# Altium schematic sheet fpga.SchDoc (part 3 of 3)
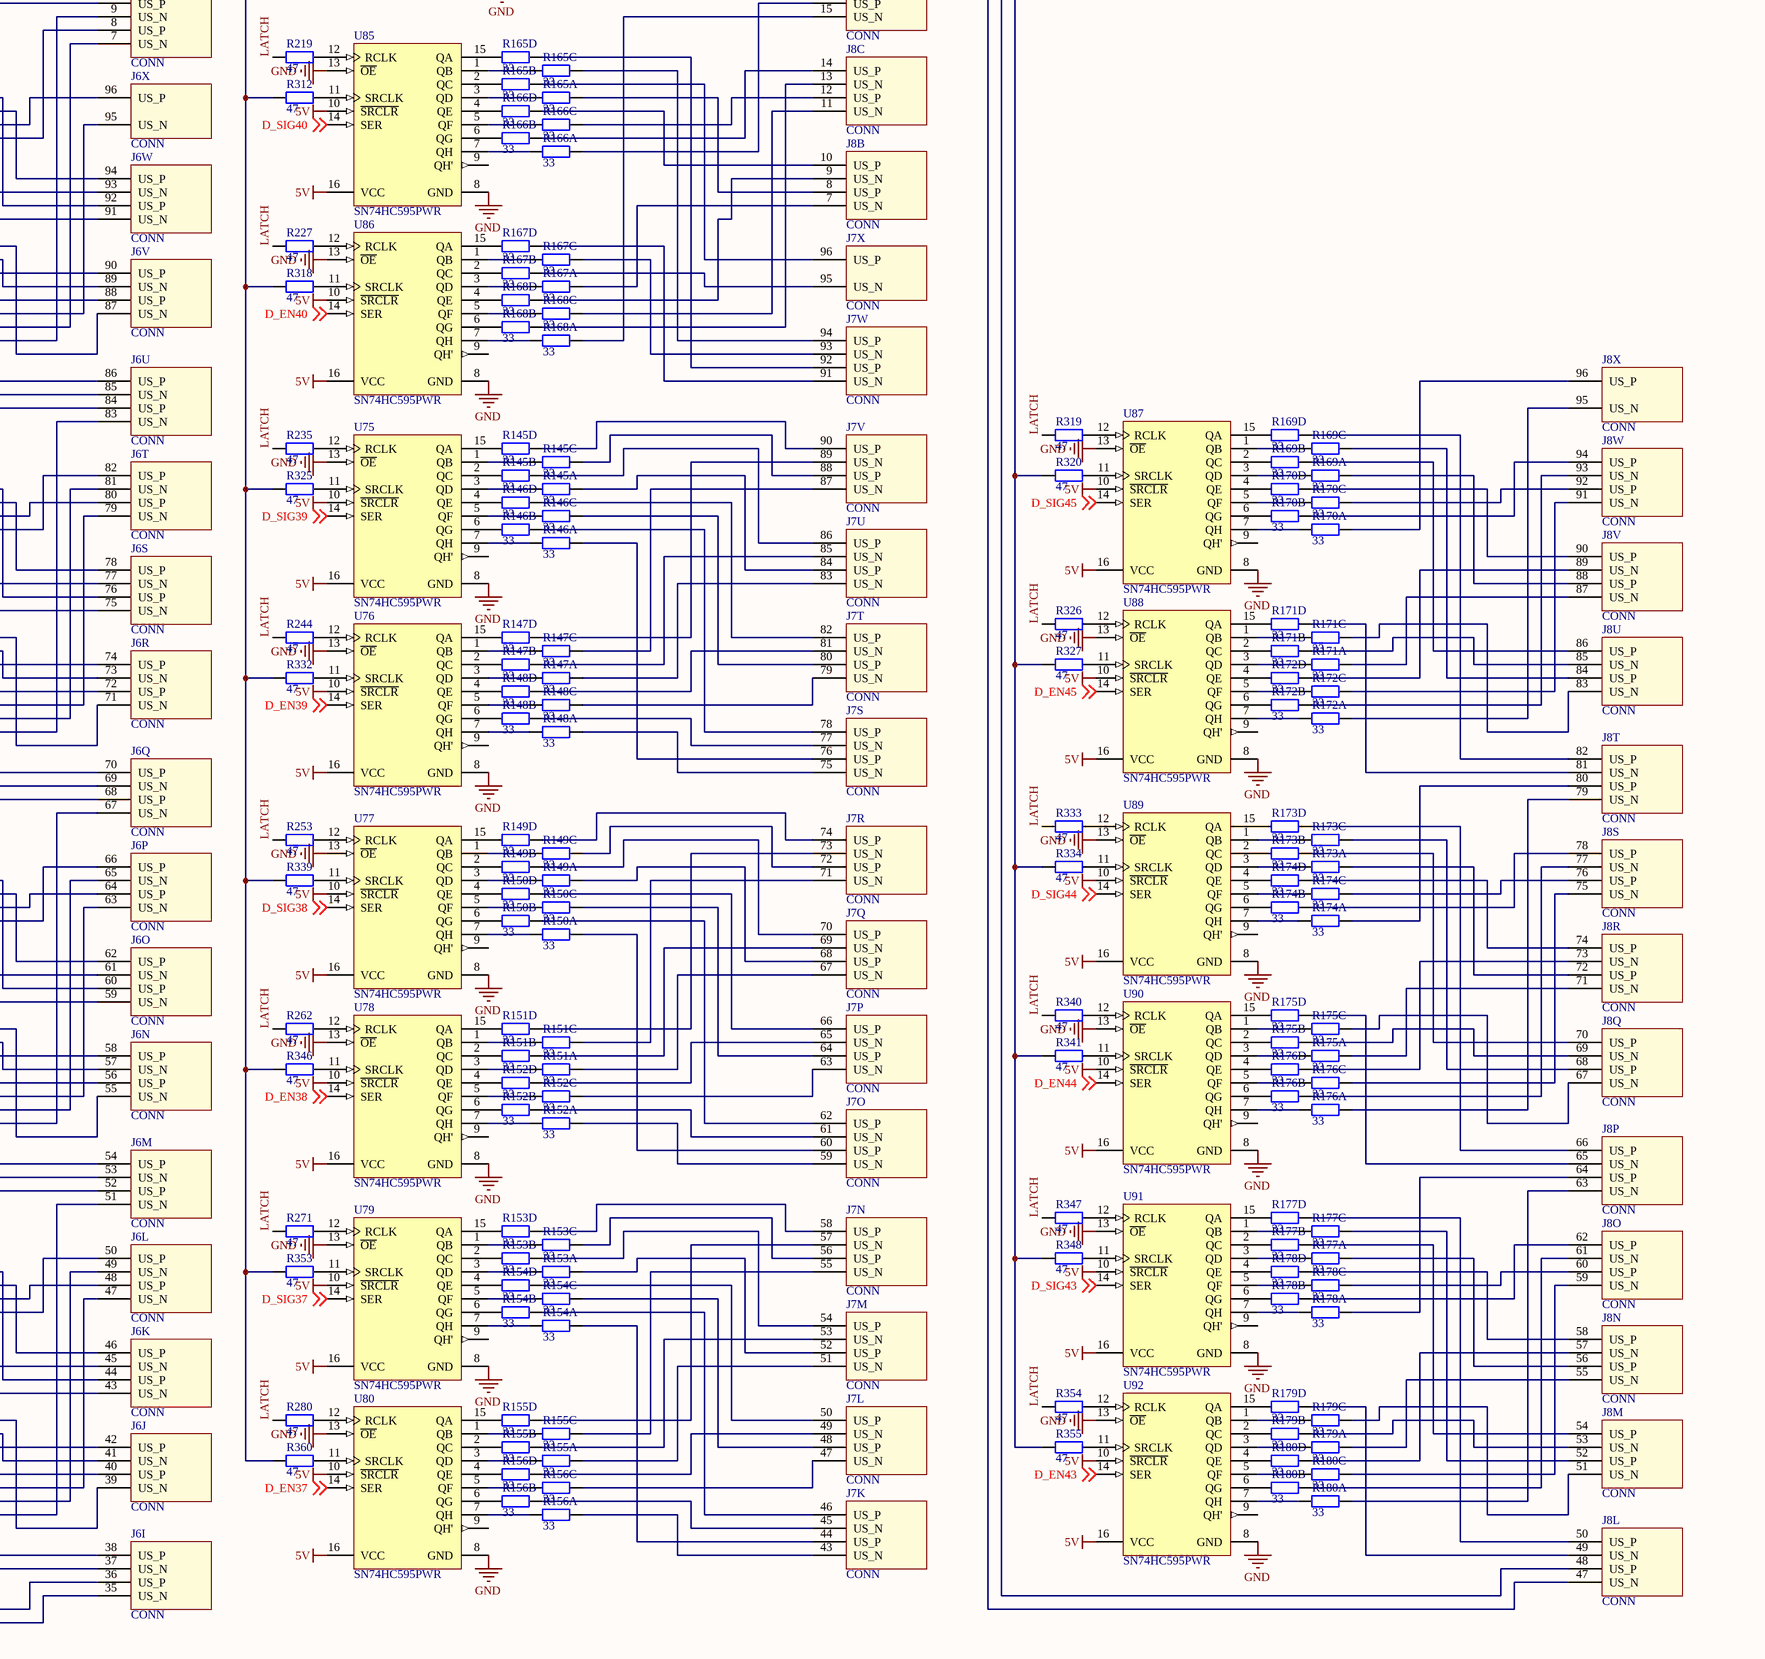
[diagram p7: fpga.SchDoc, bottom right]

## Nets (continued)
NetR166_3: R166.3 U85.5(QF)
NetR166_4: R166.4 U85.4(QE)
NetR167_1: R167.1 U86.3(QD)
NetR167_2: R167.2 U86.2(QC)
NetR167_3: R167.3 U86.1(QB)
NetR167_4: R167.4 U86.15(QA)
NetR168_1: R168.1 U86.7(QH)
NetR168_2: R168.2 U86.6(QG)
NetR168_3: R168.3 U86.5(QF)
NetR168_4: R168.4 U86.4(QE)
NetR169_1: R169.1 U87.3(QD)
NetR169_2: R169.2 U87.2(QC)
NetR169_3: R169.3 U87.1(QB)
NetR169_4: R169.4 U87.15(QA)
NetR170_1: R170.1 U87.7(QH)
NetR170_2: R170.2 U87.6(QG)
NetR170_3: R170.3 U87.5(QF)
NetR170_4: R170.4 U87.4(QE)
NetR171_1: R171.1 U88.3(QD)
NetR171_2: R171.2 U88.2(QC)
NetR171_3: R171.3 U88.1(QB)
NetR171_4: R171.4 U88.15(QA)
NetR172_1: R172.1 U88.7(QH)
NetR172_2: R172.2 U88.6(QG)
NetR172_3: R172.3 U88.5(QF)
NetR172_4: R172.4 U88.4(QE)
NetR173_1: R173.1 U89.3(QD)
NetR173_2: R173.2 U89.2(QC)
NetR173_3: R173.3 U89.1(QB)
NetR173_4: R173.4 U89.15(QA)
NetR174_1: R174.1 U89.7(QH)
NetR174_2: R174.2 U89.6(QG)
NetR174_3: R174.3 U89.5(QF)
NetR174_4: R174.4 U89.4(QE)
NetR175_1: R175.1 U90.3(QD)
NetR175_2: R175.2 U90.2(QC)
NetR175_3: R175.3 U90.1(QB)
NetR175_4: R175.4 U90.15(QA)
NetR176_1: R176.1 U90.7(QH)
NetR176_2: R176.2 U90.6(QG)
NetR176_3: R176.3 U90.5(QF)
NetR176_4: R176.4 U90.4(QE)
NetR177_1: R177.1 U91.3(QD)
NetR177_2: R177.2 U91.2(QC)
NetR177_3: R177.3 U91.1(QB)
NetR177_4: R177.4 U91.15(QA)
NetR178_1: R178.1 U91.7(QH)
NetR178_2: R178.2 U91.6(QG)
NetR178_3: R178.3 U91.5(QF)
NetR178_4: R178.4 U91.4(QE)
NetR179_1: R179.1 U92.3(QD)
NetR179_2: R179.2 U92.2(QC)
NetR179_3: R179.3 U92.1(QB)
NetR179_4: R179.4 U92.15(QA)
NetR180_1: R180.1 U92.7(QH)
NetR180_2: R180.2 U92.6(QG)
NetR180_3: R180.3 U92.5(QF)
NetR180_4: R180.4 U92.4(QE)
NetR181_2: R181.2 U71.12(RCLK)
NetR182_2: R182.2 U81.12(RCLK)
NetR183_2: R183.2 U1.12(RCLK)
NetR184_2: R184.2 U2.12(RCLK)
NetR185_2: R185.2 U27.12(RCLK)
NetR186_2: R186.2 U39.12(RCLK)
NetR187_2: R187.2 U51.12(RCLK)
NetR188_2: R188.2 U1.11(SRCLK)
NetR189_2: R189.2 U72.12(RCLK)
NetR190_2: R190.2 U82.12(RCLK)
NetR191_2: R191.2 U3.12(RCLK)
NetR192_2: R192.2 U4.12(RCLK)
NetR193_2: R193.2 U28.12(RCLK)
NetR194_2: R194.2 U40.12(RCLK)
NetR195_2: R195.2 U52.12(RCLK)
NetR196_2: R196.2 U3.11(SRCLK)
NetR197_2: R197.2 U73.12(RCLK)
NetR198_2: R198.2 U83.12(RCLK)
NetR199_2: R199.2 U5.12(RCLK)
NetR200_2: R200.2 U6.12(RCLK)
NetR201_2: R201.2 U29.12(RCLK)
NetR202_2: R202.2 U41.12(RCLK)
NetR203_2: R203.2 U53.12(RCLK)
NetR204_2: R204.2 U5.11(SRCLK)
NetR205_2: R205.2 U74.12(RCLK)
NetR206_2: R206.2 U84.12(RCLK)
NetR207_2: R207.2 U7.12(RCLK)
NetR208_2: R208.2 U8.12(RCLK)
NetR209_2: R209.2 U30.12(RCLK)
NetR210_2: R210.2 U42.12(RCLK)
NetR211_2: R211.2 U54.12(RCLK)
NetR212_2: R212.2 U7.11(SRCLK)
NetR213_2: R213.2 U9.12(RCLK)
NetR214_2: R214.2 U10.12(RCLK)
NetR215_2: R215.2 U31.12(RCLK)
NetR216_2: R216.2 U43.12(RCLK)
NetR217_2: R217.2 U55.12(RCLK)
NetR218_2: R218.2 U63.12(RCLK)
NetR219_2: R219.2 U85.12(RCLK)
NetR220_2: R220.2 U9.11(SRCLK)
NetR221_2: R221.2 U11.12(RCLK)
NetR222_2: R222.2 U12.12(RCLK)
NetR223_2: R223.2 U32.12(RCLK)
NetR224_2: R224.2 U44.12(RCLK)
NetR225_2: R225.2 U56.12(RCLK)
NetR226_2: R226.2 U64.12(RCLK)
NetR227_2: R227.2 U86.12(RCLK)
NetR228_2: R228.2 U11.11(SRCLK)
NetR229_2: R229.2 U13.12(RCLK)
NetR230_2: R230.2 U14.12(RCLK)
NetR231_2: R231.2 U33.12(RCLK)
NetR232_2: R232.2 U45.12(RCLK)
NetR233_2: R233.2 U57.12(RCLK)
NetR234_2: R234.2 U65.12(RCLK)
NetR235_2: R235.2 U75.12(RCLK)
NetR236_2: R236.2 U13.11(SRCLK)
NetR237_2: R237.2 U14.11(SRCLK)
NetR238_2: R238.2 U15.12(RCLK)
NetR239_2: R239.2 U16.12(RCLK)
NetR240_2: R240.2 U34.12(RCLK)
NetR241_2: R241.2 U46.12(RCLK)
NetR242_2: R242.2 U58.12(RCLK)
NetR243_2: R243.2 U66.12(RCLK)
NetR244_2: R244.2 U76.12(RCLK)
NetR245_2: R245.2 U15.11(SRCLK)
NetR246_2: R246.2 U16.11(SRCLK)
NetR247_2: R247.2 U17.12(RCLK)
NetR248_2: R248.2 U18.12(RCLK)
NetR249_2: R249.2 U35.12(RCLK)
NetR250_2: R250.2 U47.12(RCLK)
NetR251_2: R251.2 U59.12(RCLK)
NetR252_2: R252.2 U67.12(RCLK)
NetR253_2: R253.2 U77.12(RCLK)
NetR254_2: R254.2 U17.11(SRCLK)
NetR255_2: R255.2 U18.11(SRCLK)
NetR256_2: R256.2 U19.12(RCLK)
NetR257_2: R257.2 U20.12(RCLK)
NetR258_2: R258.2 U36.12(RCLK)
NetR259_2: R259.2 U48.12(RCLK)
NetR260_2: R260.2 U60.12(RCLK)
NetR261_2: R261.2 U68.12(RCLK)
NetR262_2: R262.2 U78.12(RCLK)
NetR263_2: R263.2 U19.11(SRCLK)
NetR264_2: R264.2 U20.11(SRCLK)
NetR265_2: R265.2 U21.12(RCLK)
NetR266_2: R266.2 U22.12(RCLK)
NetR267_2: R267.2 U37.12(RCLK)
NetR268_2: R268.2 U49.12(RCLK)
NetR269_2: R269.2 U61.12(RCLK)
NetR270_2: R270.2 U69.12(RCLK)
NetR271_2: R271.2 U79.12(RCLK)
NetR272_2: R272.2 U21.11(SRCLK)
NetR273_2: R273.2 U22.11(SRCLK)
NetR274_2: R274.2 U23.12(RCLK)
NetR275_2: R275.2 U24.12(RCLK)
NetR276_2: R276.2 U38.12(RCLK)
NetR277_2: R277.2 U50.12(RCLK)
NetR278_2: R278.2 U62.12(RCLK)
NetR279_2: R279.2 U70.12(RCLK)
NetR280_2: R280.2 U80.12(RCLK)
NetR281_2: R281.2 U23.11(SRCLK)
NetR282_2: R282.2 U24.11(SRCLK)
NetR283_2: R283.2 U71.11(SRCLK)
NetR284_2: R284.2 U81.11(SRCLK)
NetR285_2: R285.2 U2.11(SRCLK)
NetR286_2: R286.2 U27.11(SRCLK)
NetR287_2: R287.2 U39.11(SRCLK)
NetR288_2: R288.2 U51.11(SRCLK)
NetR289_2: R289.2 U72.11(SRCLK)
NetR290_2: R290.2 U82.11(SRCLK)
NetR291_2: R291.2 U4.11(SRCLK)
NetR292_2: R292.2 U28.11(SRCLK)
NetR293_2: R293.2 U40.11(SRCLK)
NetR294_2: R294.2 U52.11(SRCLK)
NetR295_2: R295.2 U73.11(SRCLK)
NetR296_2: R296.2 U83.11(SRCLK)
NetR297_2: R297.2 U6.11(SRCLK)
NetR298_2: R298.2 U29.11(SRCLK)
NetR299_2: R299.2 U41.11(SRCLK)
NetR300_2: R300.2 U53.11(SRCLK)
NetR301_2: R301.2 U74.11(SRCLK)
NetR302_2: R302.2 U84.11(SRCLK)
NetR303_2: R303.2 U8.11(SRCLK)
NetR304_2: R304.2 U30.11(SRCLK)
NetR305_2: R305.2 U42.11(SRCLK)
NetR306_2: R306.2 U54.11(SRCLK)
NetR307_2: R307.2 U10.11(SRCLK)
NetR308_2: R308.2 U31.11(SRCLK)
NetR309_2: R309.2 U43.11(SRCLK)
NetR310_2: R310.2 U55.11(SRCLK)
NetR311_2: R311.2 U63.11(SRCLK)
NetR312_2: R312.2 U85.11(SRCLK)
NetR313_2: R313.2 U12.11(SRCLK)
NetR314_2: R314.2 U32.11(SRCLK)
NetR315_2: R315.2 U44.11(SRCLK)
NetR316_2: R316.2 U56.11(SRCLK)
NetR317_2: R317.2 U64.11(SRCLK)
NetR318_2: R318.2 U86.11(SRCLK)
NetR319_2: R319.2 U87.12(RCLK)
NetR320_2: R320.2 U87.11(SRCLK)
NetR321_2: R321.2 U33.11(SRCLK)
NetR322_2: R322.2 U45.11(SRCLK)
NetR323_2: R323.2 U57.11(SRCLK)
NetR324_2: R324.2 U65.11(SRCLK)
NetR325_2: R325.2 U75.11(SRCLK)
NetR326_2: R326.2 U88.12(RCLK)
NetR327_2: R327.2 U88.11(SRCLK)
NetR328_2: R328.2 U34.11(SRCLK)
NetR329_2: R329.2 U46.11(SRCLK)
NetR330_2: R330.2 U58.11(SRCLK)
NetR331_2: R331.2 U66.11(SRCLK)
NetR332_2: R332.2 U76.11(SRCLK)
NetR333_2: R333.2 U89.12(RCLK)
NetR334_2: R334.2 U89.11(SRCLK)
NetR335_2: R335.2 U35.11(SRCLK)
NetR336_2: R336.2 U47.11(SRCLK)
NetR337_2: R337.2 U59.11(SRCLK)
NetR338_2: R338.2 U67.11(SRCLK)
NetR339_2: R339.2 U77.11(SRCLK)
NetR340_2: R340.2 U90.12(RCLK)
NetR341_2: R341.2 U90.11(SRCLK)
NetR342_2: R342.2 U36.11(SRCLK)
NetR343_2: R343.2 U48.11(SRCLK)
NetR344_2: R344.2 U60.11(SRCLK)
NetR345_2: R345.2 U68.11(SRCLK)
NetR346_2: R346.2 U78.11(SRCLK)
NetR347_2: R347.2 U91.12(RCLK)
NetR348_2: R348.2 U91.11(SRCLK)
NetR349_2: R349.2 U37.11(SRCLK)
NetR350_2: R350.2 U49.11(SRCLK)
NetR351_2: R351.2 U61.11(SRCLK)
NetR352_2: R352.2 U69.11(SRCLK)
NetR353_2: R353.2 U79.11(SRCLK)
NetR354_2: R354.2 U92.12(RCLK)
NetR355_2: R355.2 U92.11(SRCLK)
NetR356_2: R356.2 U38.11(SRCLK)
NetR357_2: R357.2 U50.11(SRCLK)
NetR358_2: R358.2 U62.11(SRCLK)
NetR359_2: R359.2 U70.11(SRCLK)
NetR360_2: R360.2 U80.11(SRCLK)

Not connected (* = marked no-connect by the designer): U1 9(QH'); U2 9(QH'); U3 9(QH'); U4 9(QH'); U5 9(QH'); U6 9(QH'); U7 9(QH'); U8 9(QH'); U9 9(QH'); U10 9(QH'); U11 9(QH'); U12 9(QH'); U13 9(QH'); U14 9(QH'); U15 9(QH'); U16 9(QH'); U17 9(QH'); U18 9(QH'); U19 9(QH'); U20 9(QH'); U21 9(QH'); U22 9(QH'); U23 9(QH'); U24 9(QH'); U27 9(QH'); U28 9(QH'); U29 9(QH'); U30 9(QH'); U31 9(QH'); U32 9(QH'); U33 9(QH'); U34 9(QH'); U35 9(QH'); U36 9(QH'); U37 9(QH'); U38 9(QH'); U39 9(QH'); U40 9(QH'); U41 9(QH'); U42 9(QH'); U43 9(QH'); U44 9(QH'); U45 9(QH'); U46 9(QH'); U47 9(QH'); U48 9(QH'); U49 9(QH'); U50 9(QH'); U51 9(QH'); U52 9(QH'); U53 9(QH'); U54 9(QH'); U55 9(QH'); U56 9(QH'); U57 9(QH'); U58 9(QH'); U59 9(QH'); U60 9(QH'); U61 9(QH'); U62 9(QH'); U63 9(QH'); U64 9(QH'); U65 9(QH'); U66 9(QH'); U67 9(QH'); U68 9(QH'); U69 9(QH'); U70 9(QH'); U71 9(QH'); U72 9(QH'); U73 9(QH'); U74 9(QH'); U75 9(QH'); U76 9(QH'); U77 9(QH'); U78 9(QH'); U79 9(QH'); U80 9(QH'); U81 9(QH'); U82 9(QH'); U83 9(QH'); U84 9(QH'); U85 9(QH'); U86 9(QH'); U87 9(QH'); U88 9(QH'); U89 9(QH'); U90 9(QH'); U91 9(QH'); U92 9(QH')

## Notes on the sheet
- Labels drawn without touching a wire or pin: LATCH
- Title
- Size:
- Date:
- File:
- A0
- Number:
- Time:
- Revision:
- Sheet
- of

## Library data of the parts
C1-C90 = C-0603-100n-50V: Capacitor 100n 50V; Supplier 1: Mouser; Supplier Part Number 1: 80-C0603C104K5RAUTO
C91-C98 = C-0805-10u-25V: 3; Supplier 1: Mouser; Supplier Part Number 1: 80-C0805C106K3P
J1-J8 = PIN_HEADER_1.27_2x50
R1-R180 = R-4x33: Resistor Array 4x33; Supplier 1: Mouser; Supplier Part Number 1: 667-EXB-N8V330JX
R181-R360 = R-0603-47: Resistor 47; Supplier 1: Mouser; Supplier Part Number 1: 71-CRCW060347R0FKEB
U1-U24 U27-U92 = CMP-0780-00192-3: 8-Bit Shift Registers With 3-State Output Registers, PW0016A, LARGE T&R; Manufacturer: Texas Instruments; VCC(Max)(V): 6; Bits: 8; Output Type: CMOS; 3-State Output: Yes; Output Drive (IOL/IOH)(Max)(mA): 7.8/-7.8; VCC(Min)(V): 2; Rating: Military; tpd @ Nom Voltage(Max)(ns): 34; ICC @ Nom Voltage(Max)(mA): 0.08; Technology Family: HC; F @ Nom Voltage(Max)(Mhz): 28; PackageReference: PW0016A; Generic Part Number: SN74HC595; Operating Temperature Range(C): -40 to 85; PackageVersion: http://www.ti.com/lit/ml/mpds361/mpds361.pdf; Code_JEDEC: MO-153; DatasheetVersion: SCLS041H; Voltage(Nom)(V): 6; Input Type: CMOS